# Altium schematic sheet cgra.SchDoc
size D
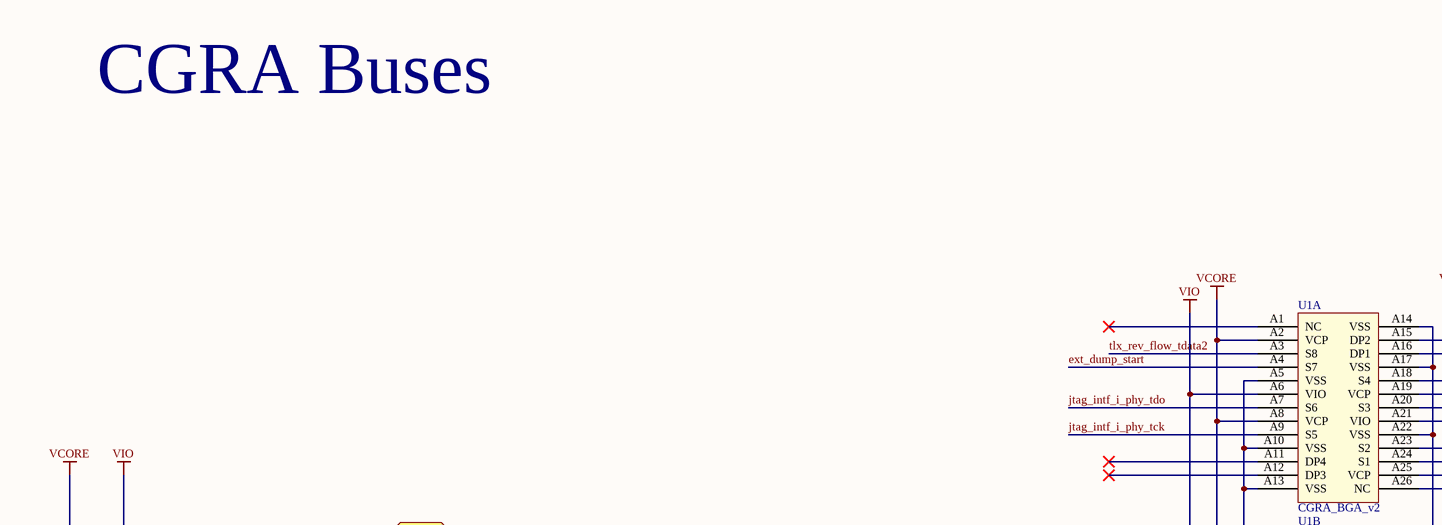
[diagram p0: cgra.SchDoc, top left]
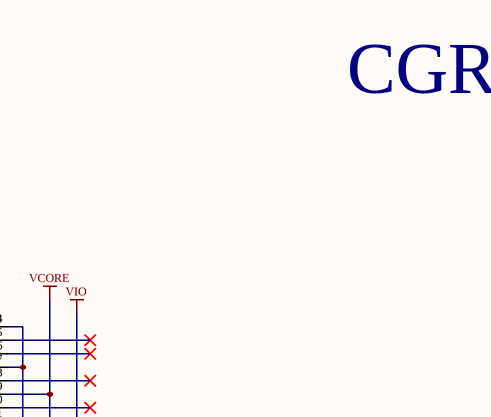
[diagram p1: cgra.SchDoc, top middle]
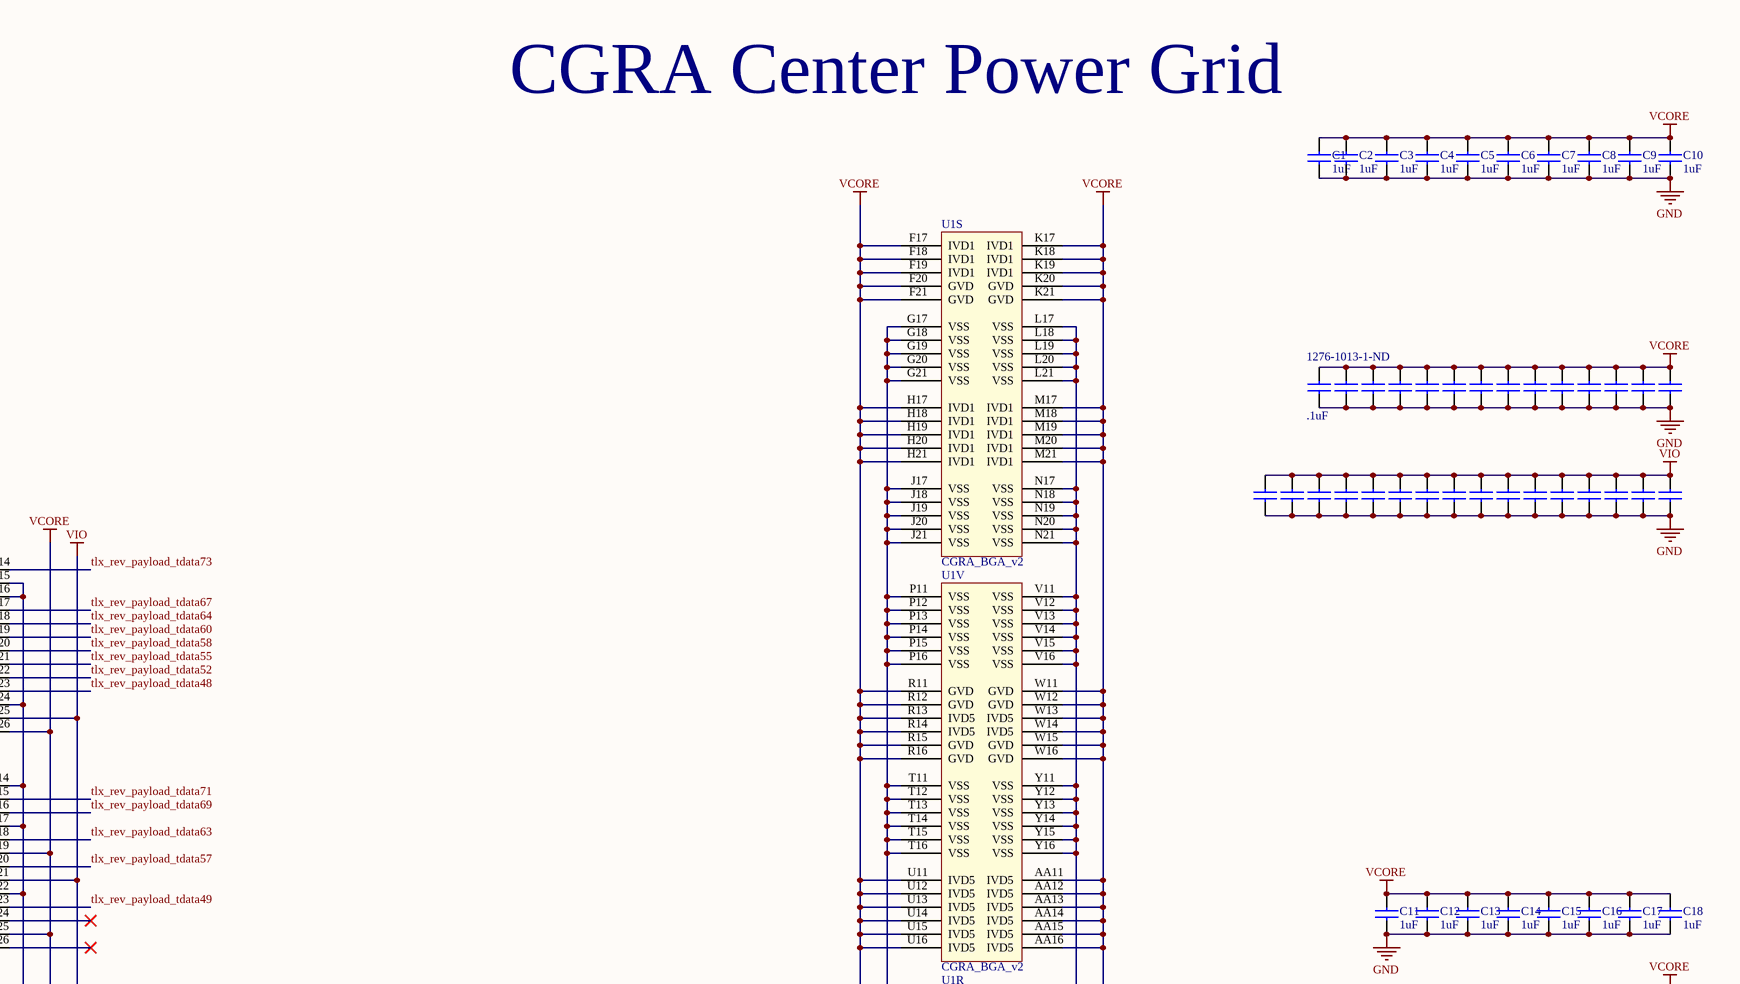
[diagram p2: cgra.SchDoc, top right]
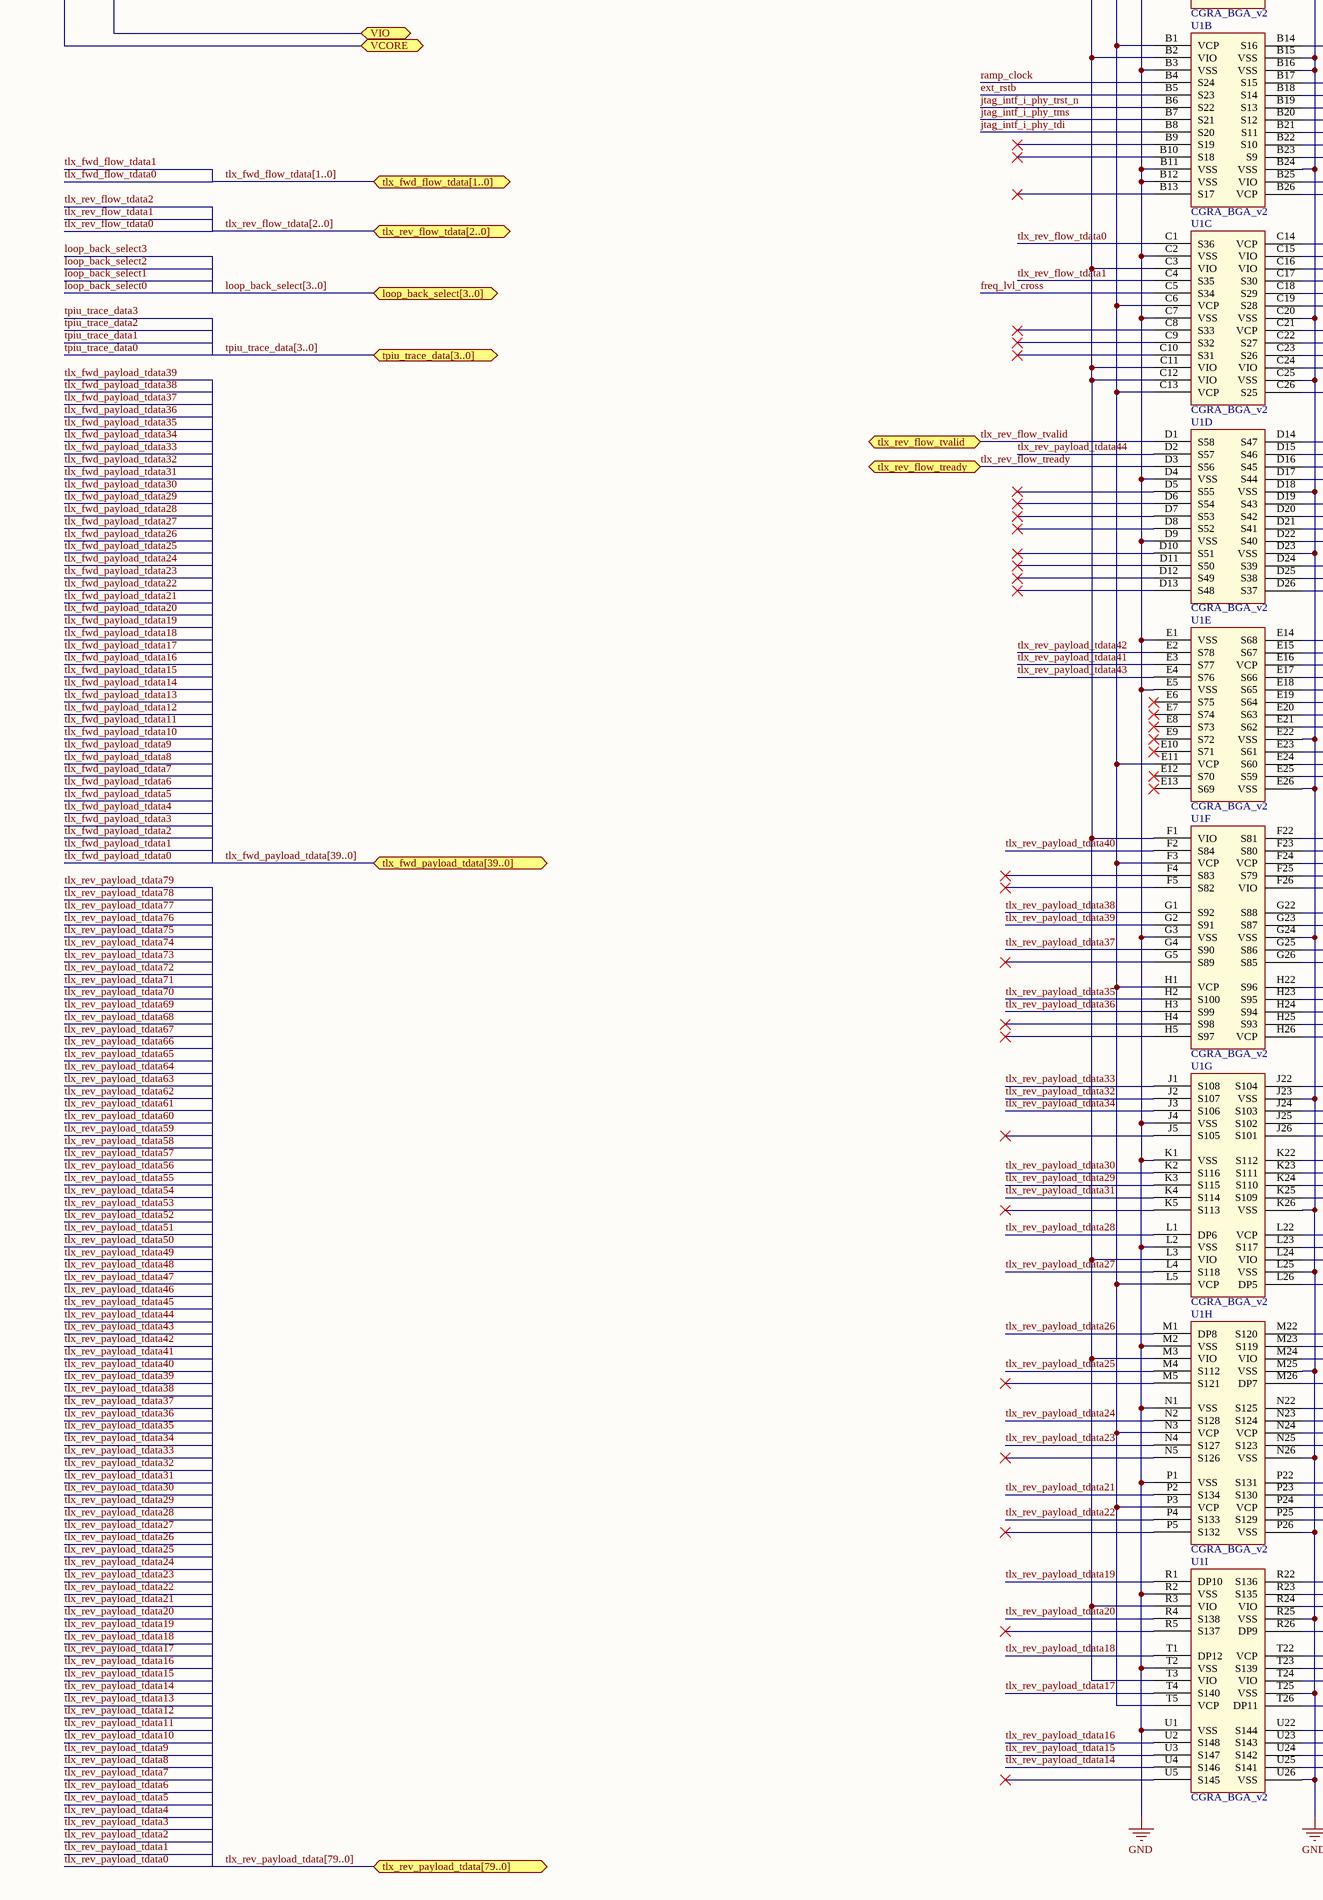
[diagram p3: cgra.SchDoc, bottom left]
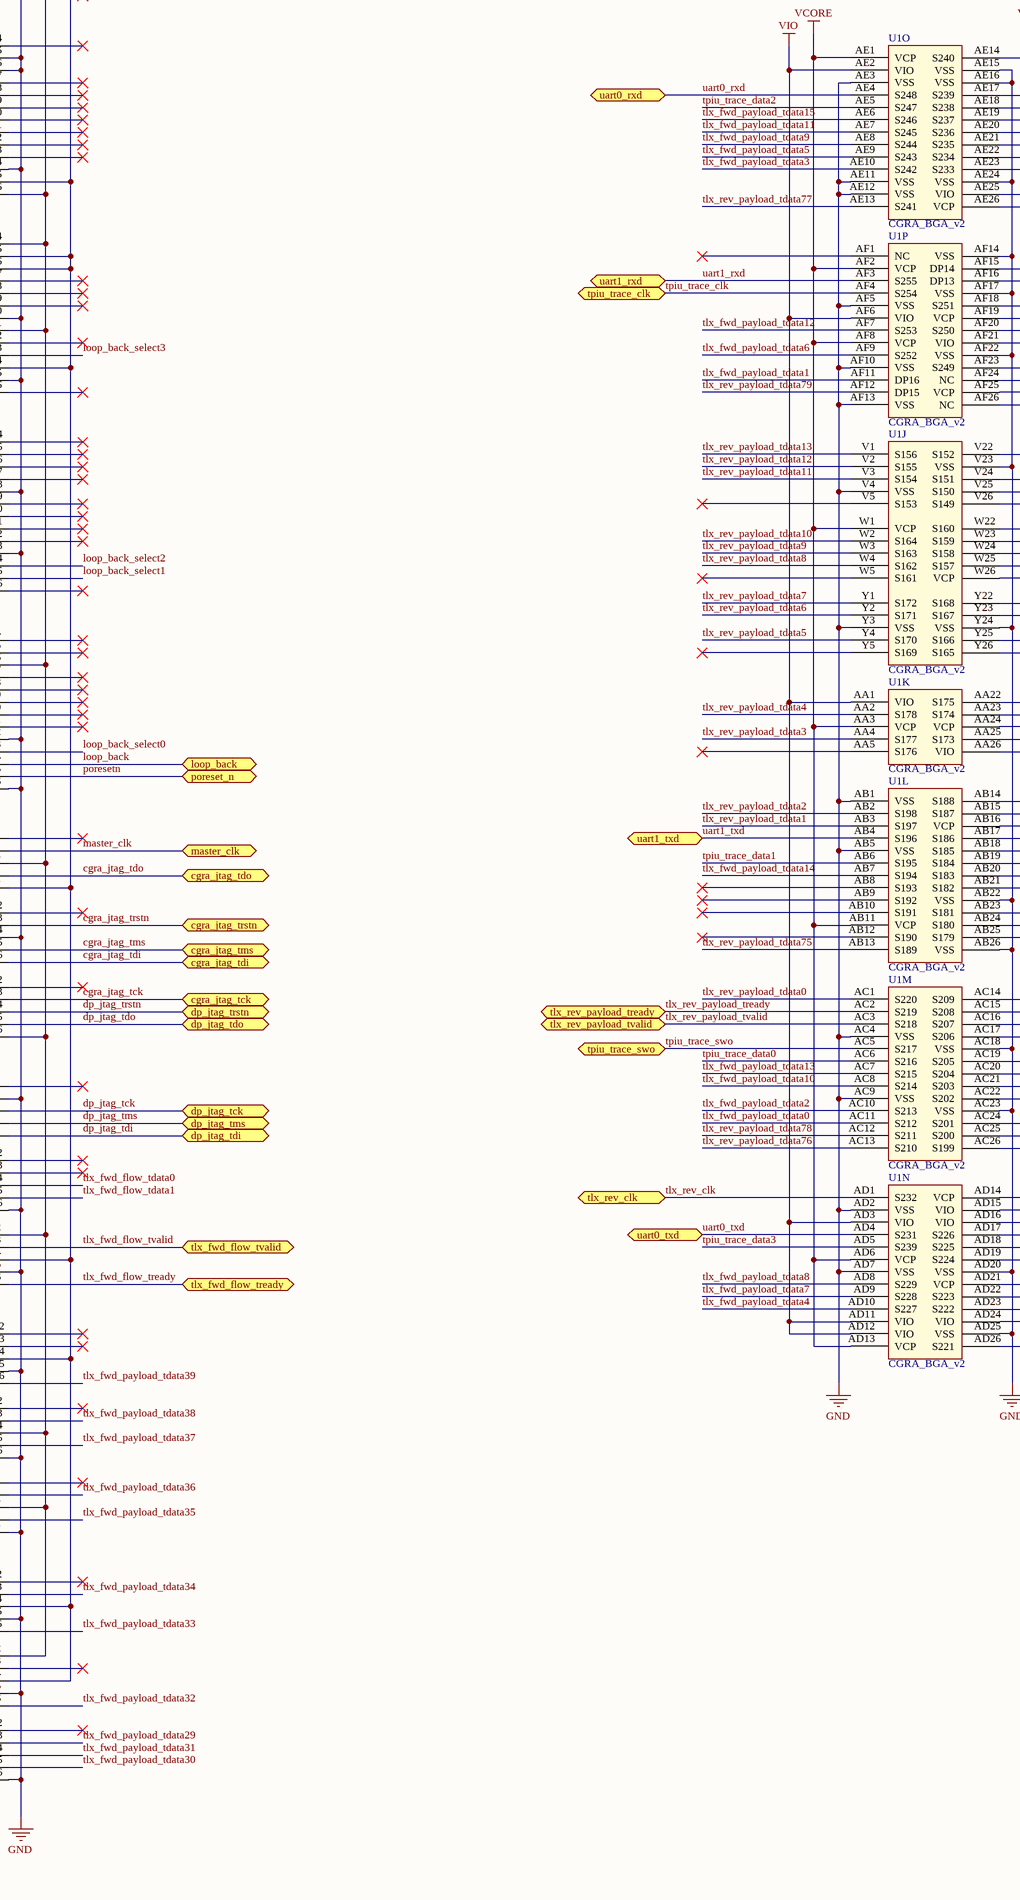
[diagram p4: cgra.SchDoc, bottom middle]
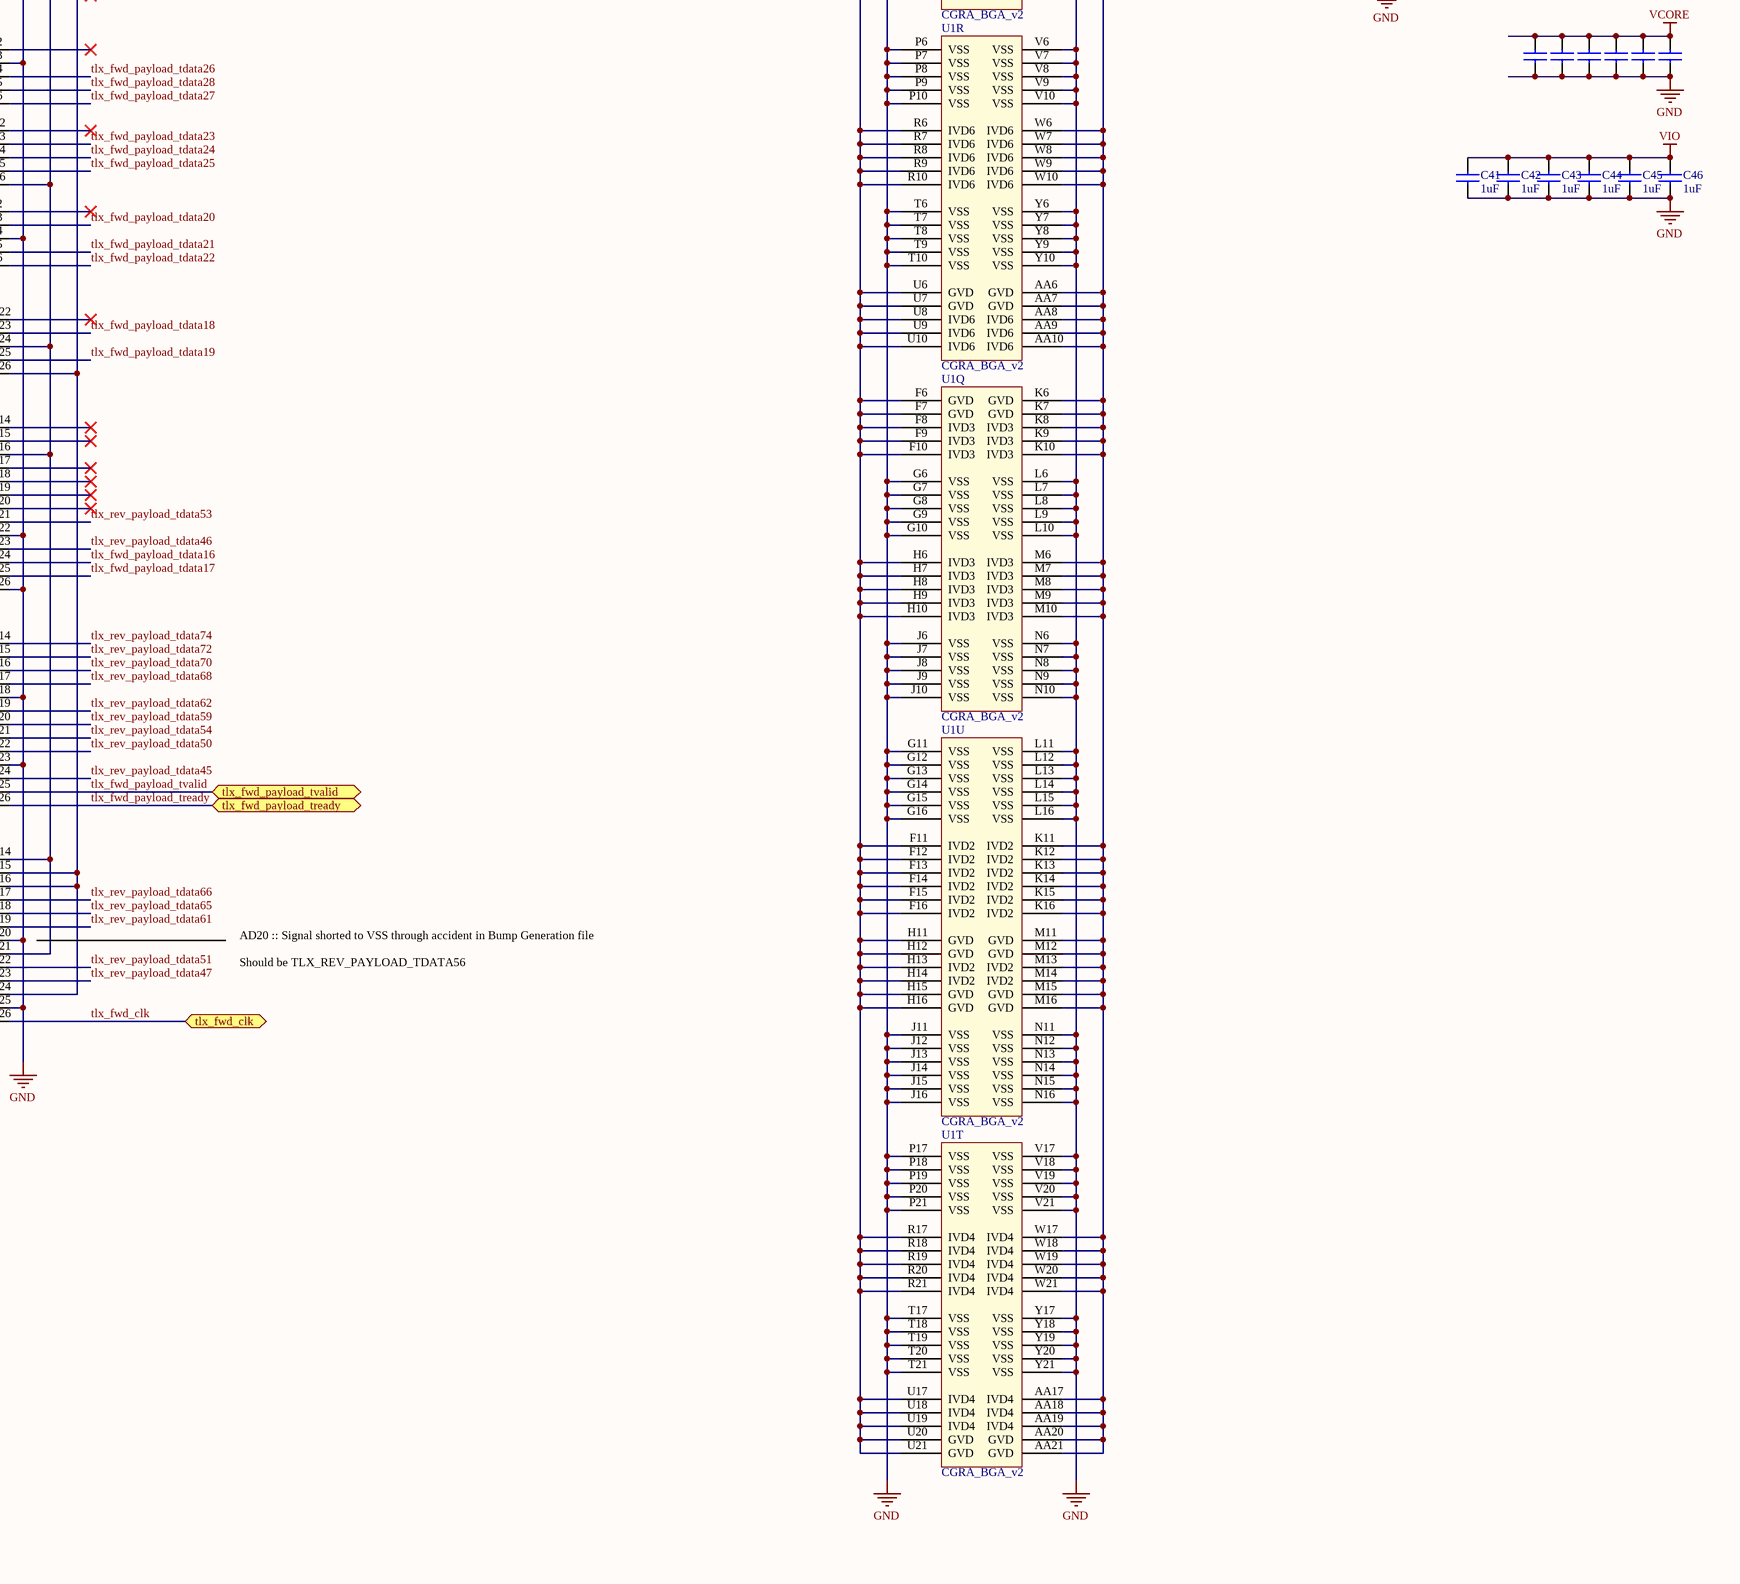
[diagram p5: cgra.SchDoc, bottom right]

## Parts
C1  Capacitance: 1uF  [CAPC2012X14N]  (hidden comment: CAP_1uF_0805_25V)
C2  Capacitance: 1uF  [CAPC2012X14N]  (hidden comment: CAP_1uF_0805_25V)
C3  Capacitance: 1uF  [CAPC2012X14N]  (hidden comment: CAP_1uF_0805_25V)
C4  Capacitance: 1uF  [CAPC2012X14N]  (hidden comment: CAP_1uF_0805_25V)
C5  Capacitance: 1uF  [CAPC2012X14N]  (hidden comment: CAP_1uF_0805_25V)
C6  Capacitance: 1uF  [CAPC2012X14N]  (hidden comment: CAP_1uF_0805_25V)
C7  Capacitance: 1uF  [CAPC2012X14N]  (hidden comment: CAP_1uF_0805_25V)
C8  Capacitance: 1uF  [CAPC2012X14N]  (hidden comment: CAP_1uF_0805_25V)
C9  Capacitance: 1uF  [CAPC2012X14N]  (hidden comment: CAP_1uF_0805_25V)
C10  Capacitance: 1uF  [CAPC2012X14N]  (hidden comment: CAP_1uF_0805_25V)
C11  Capacitance: 1uF  [CAPC2012X14N]  (hidden comment: CAP_1uF_0805_25V)
C12  Capacitance: 1uF  [CAPC2012X14N]  (hidden comment: CAP_1uF_0805_25V)
C13  Capacitance: 1uF  [CAPC2012X14N]  (hidden comment: CAP_1uF_0805_25V)
C14  Capacitance: 1uF  [CAPC2012X14N]  (hidden comment: CAP_1uF_0805_25V)
C15  Capacitance: 1uF  [CAPC2012X14N]  (hidden comment: CAP_1uF_0805_25V)
C16  Capacitance: 1uF  [CAPC2012X14N]  (hidden comment: CAP_1uF_0805_25V)
C17  Capacitance: 1uF  [CAPC2012X14N]  (hidden comment: CAP_1uF_0805_25V)
C18  Capacitance: 1uF  [CAPC2012X14N]  (hidden comment: CAP_1uF_0805_25V)
C19  Capacitance: .1uF  Supplier Part Number 1: 1276-1013-1-ND  [CAPC0603X02N]  (hidden comment: cap)
C20  cap  [CAPC0603X02N]  (value not drawn)
C21  cap  [CAPC0603X02N]  (value not drawn)
C22  cap  [CAPC0603X02N]  (value not drawn)
C23  cap  [CAPC0603X02N]  (value not drawn)
C24  cap  [CAPC0603X02N]  (value not drawn)
C25  cap  [CAPC0603X02N]  (value not drawn)
C26  cap  [CAPC0603X02N]  (value not drawn)
C27  cap  [CAPC0603X02N]  (value not drawn)
C28  cap  [CAPC0603X02N]  (value not drawn)
C29  cap  [CAPC0603X02N]  (value not drawn)
C30  cap  [CAPC0603X02N]  (value not drawn)
C31  cap  [CAPC0603X02N]  (value not drawn)
C32  cap  [CAPC0603X02N]  (value not drawn)
C41  Capacitance: 1uF  [CAPC2012X14N]  (hidden comment: CAP_1uF_0805_25V)
C42  Capacitance: 1uF  [CAPC2012X14N]  (hidden comment: CAP_1uF_0805_25V)
C43  Capacitance: 1uF  [CAPC2012X14N]  (hidden comment: CAP_1uF_0805_25V)
C44  Capacitance: 1uF  [CAPC2012X14N]  (hidden comment: CAP_1uF_0805_25V)
C45  Capacitance: 1uF  [CAPC2012X14N]  (hidden comment: CAP_1uF_0805_25V)
C46  Capacitance: 1uF  [CAPC2012X14N]  (hidden comment: CAP_1uF_0805_25V)
C96  cap  [CAPC0603X02N]  (value not drawn)
C97  cap  [CAPC0603X02N]  (value not drawn)
C98  cap  [CAPC0603X02N]  (value not drawn)
C99  cap  [CAPC0603X02N]  (value not drawn)
C100  cap  [CAPC0603X02N]  (value not drawn)
C101  cap  [CAPC0603X02N]  (value not drawn)
C106  cap  [CAPC0603X02N]  (value not drawn)
C107  cap  [CAPC0603X02N]  (value not drawn)
C108  cap  [CAPC0603X02N]  (value not drawn)
C109  cap  [CAPC0603X02N]  (value not drawn)
C110  cap  [CAPC0603X02N]  (value not drawn)
C111  cap  [CAPC0603X02N]  (value not drawn)
C112  cap  [CAPC0603X02N]  (value not drawn)
C113  cap  [CAPC0603X02N]  (value not drawn)
C114  cap  [CAPC0603X02N]  (value not drawn)
C115  cap  [CAPC0603X02N]  (value not drawn)
C116  cap  [CAPC0603X02N]  (value not drawn)
C117  cap  [CAPC0603X02N]  (value not drawn)
C118  cap  [CAPC0603X02N]  (value not drawn)
C119  cap  [CAPC0603X02N]  (value not drawn)
C120  cap  [CAPC0603X02N]  (value not drawn)
C121  cap  [CAPC0603X02N]  (value not drawn)
U1  CGRA_BGA_v2  [BGA676x26]  (parts A,B,C,D,E,F,G,H,I,J,K,L,M,N,O,P,Q,R,S,T,U,V of 22)

## Ports
cgra_jtag_tck (bidir), cgra_jtag_tdi (bidir), cgra_jtag_tdo (bidir), cgra_jtag_tms (bidir), cgra_jtag_trstn (bidir), dp_jtag_tck (bidir), dp_jtag_tdi (bidir), dp_jtag_tdo (bidir), dp_jtag_tms (bidir), dp_jtag_trstn (bidir), loop_back (bidir), loop_back_select[3..0] (bidir), master_clk (bidir), poreset_n (bidir), tlx_fwd_clk (bidir), tlx_fwd_flow_tdata[1..0] (bidir), tlx_fwd_flow_tready (bidir), tlx_fwd_flow_tvalid (bidir), tlx_fwd_payload_tdata[39..0] (bidir), tlx_fwd_payload_tready (bidir), tlx_fwd_payload_tvalid (bidir), tlx_rev_clk (bidir), tlx_rev_flow_tdata[2..0] (bidir), tlx_rev_flow_tready (bidir), tlx_rev_flow_tvalid (bidir), tlx_rev_payload_tdata[79..0] (bidir), tlx_rev_payload_tready (bidir), tlx_rev_payload_tvalid (bidir), tpiu_trace_clk (bidir), tpiu_trace_data[3..0] (bidir), tpiu_trace_swo (bidir), uart0_rxd (bidir), uart0_txd (bidir), uart1_rxd (bidir), uart1_txd (bidir), VCORE (bidir), VIO (bidir)

## Nets
GND: C1.2 C2.2 C3.2 C4.2 C5.2 C6.2 C7.2 C8.2 C9.2 C10.2 C11.2 C12.2 C13.2 C14.2 C15.2 C16.2 C17.2 C18.2 C19.2 C20.2 C21.2 C22.2 C23.2 C24.2 C25.2 C26.2 C27.2 C28.2 C29.2 C30.2 C31.2 C32.2 C41.2 C42.2 C43.2 C44.2 C45.2 C46.2 C96.2 C97.2 C98.2 C99.2 C100.2 C101.2 C106.2 C107.2 C108.2 C109.2 C110.2 C111.2 C112.2 C113.2 C114.2 C115.2 C116.2 C117.2 C118.2 C119.2 C120.2 C121.2 U1.A5(VSS) U1.A10(VSS) U1.A13(VSS) U1.A14(VSS) U1.A17(VSS) U1.A22(VSS) U1.AB1(VSS) U1.AB5(VSS) U1.AB22(VSS) U1.AB26(VSS) U1.AC4(VSS) U1.AC9(VSS) U1.AC18(VSS) U1.AC23(VSS) U1.AD2(VSS) U1.AD7(VSS) U1.AD20(VSS) U1.AD25(VSS) U1.AE3(VSS) U1.AE11(VSS) U1.AE12(VSS) U1.AE15(VSS) U1.AE16(VSS) U1.AE24(VSS) U1.AF5(VSS) U1.AF10(VSS) U1.AF13(VSS) U1.AF14(VSS) U1.AF17(VSS) U1.AF22(VSS) U1.B3(VSS) U1.B11(VSS) U1.B12(VSS) U1.B15(VSS) U1.B16(VSS) U1.B24(VSS) U1.C2(VSS) U1.C7(VSS) U1.C20(VSS) U1.C25(VSS) U1.D4(VSS) U1.D9(VSS) U1.D18(VSS) U1.D23(VSS) U1.E1(VSS) U1.E5(VSS) U1.E22(VSS) U1.E26(VSS) U1.G3(VSS) U1.G6(VSS) U1.G7(VSS) U1.G8(VSS) U1.G9(VSS) U1.G10(VSS) U1.G11(VSS) U1.G12(VSS) U1.G13(VSS) U1.G14(VSS) U1.G15(VSS) U1.G16(VSS) U1.G17(VSS) U1.G18(VSS) U1.G19(VSS) U1.G20(VSS) U1.G21(VSS) U1.G24(VSS) U1.J4(VSS) U1.J6(VSS) U1.J7(VSS) U1.J8(VSS) U1.J9(VSS) U1.J10(VSS) U1.J11(VSS) U1.J12(VSS) U1.J13(VSS) U1.J14(VSS) U1.J15(VSS) U1.J16(VSS) U1.J17(VSS) U1.J18(VSS) U1.J19(VSS) U1.J20(VSS) U1.J21(VSS) U1.J23(VSS) U1.K1(VSS) U1.K26(VSS) U1.L2(VSS) U1.L6(VSS) U1.L7(VSS) U1.L8(VSS) U1.L9(VSS) U1.L10(VSS) U1.L11(VSS) U1.L12(VSS) U1.L13(VSS) U1.L14(VSS) U1.L15(VSS) U1.L16(VSS) U1.L17(VSS) U1.L18(VSS) U1.L19(VSS) U1.L20(VSS) U1.L21(VSS) U1.L25(VSS) U1.M2(VSS) U1.M25(VSS) U1.N1(VSS) U1.N6(VSS) U1.N7(VSS) U1.N8(VSS) U1.N9(VSS) U1.N10(VSS) U1.N11(VSS) U1.N12(VSS) U1.N13(VSS) U1.N14(VSS) U1.N15(VSS) U1.N16(VSS) U1.N17(VSS) U1.N18(VSS) U1.N19(VSS) U1.N20(VSS) U1.N21(VSS) U1.N26(VSS) U1.P1(VSS) U1.P6(VSS) U1.P7(VSS) U1.P8(VSS) U1.P9(VSS) U1.P10(VSS) U1.P11(VSS) U1.P12(VSS) U1.P13(VSS) U1.P14(VSS) U1.P15(VSS) U1.P16(VSS) U1.P17(VSS) U1.P18(VSS) U1.P19(VSS) U1.P20(VSS) U1.P21(VSS) U1.P26(VSS) U1.R2(VSS) U1.R25(VSS) U1.T2(VSS) U1.T6(VSS) U1.T7(VSS) U1.T8(VSS) U1.T9(VSS) U1.T10(VSS) U1.T11(VSS) U1.T12(VSS) U1.T13(VSS) U1.T14(VSS) U1.T15(VSS) U1.T16(VSS) U1.T17(VSS) U1.T18(VSS) U1.T19(VSS) U1.T20(VSS) U1.T21(VSS) U1.T25(VSS) U1.U1(VSS) U1.U26(VSS) U1.V4(VSS) U1.V6(VSS) U1.V7(VSS) U1.V8(VSS) U1.V9(VSS) U1.V10(VSS) U1.V11(VSS) U1.V12(VSS) U1.V13(VSS) U1.V14(VSS) U1.V15(VSS) U1.V16(VSS) U1.V17(VSS) U1.V18(VSS) U1.V19(VSS) U1.V20(VSS) U1.V21(VSS) U1.V23(VSS) U1.Y3(VSS) U1.Y6(VSS) U1.Y7(VSS) U1.Y8(VSS) U1.Y9(VSS) U1.Y10(VSS) U1.Y11(VSS) U1.Y12(VSS) U1.Y13(VSS) U1.Y14(VSS) U1.Y15(VSS) U1.Y16(VSS) U1.Y17(VSS) U1.Y18(VSS) U1.Y19(VSS) U1.Y20(VSS) U1.Y21(VSS) U1.Y24(VSS)
VCORE: C1.1 C2.1 C3.1 C4.1 C5.1 C6.1 C7.1 C8.1 C9.1 C10.1 C11.1 C12.1 C13.1 C14.1 C15.1 C16.1 C17.1 C18.1 C19.1 C20.1 C21.1 C22.1 C23.1 C24.1 C25.1 C26.1 C27.1 C28.1 C29.1 C30.1 C31.1 C32.1 C96.1 C97.1 C98.1 C99.1 C100.1 C101.1 U1.A2(VCP) U1.A8(VCP) U1.A19(VCP) U1.A25(VCP) U1.AA3(VCP) U1.AA6(GVD) U1.AA7(GVD) U1.AA8(IVD6) U1.AA9(IVD6) U1.AA10(IVD6) U1.AA11(IVD5) U1.AA12(IVD5) U1.AA13(IVD5) U1.AA14(IVD5) U1.AA15(IVD5) U1.AA16(IVD5) U1.AA17(IVD4) U1.AA18(IVD4) U1.AA19(IVD4) U1.AA20(GVD) U1.AA21(GVD) U1.AA24(VCP) U1.AB11(VCP) U1.AB16(VCP) U1.AD6(VCP) U1.AD13(VCP) U1.AD14(VCP) U1.AD21(VCP) U1.AE1(VCP) U1.AE26(VCP) U1.AF2(VCP) U1.AF8(VCP) U1.AF19(VCP) U1.AF25(VCP) U1.B1(VCP) U1.B26(VCP) U1.C6(VCP) U1.C13(VCP) U1.C14(VCP) U1.C21(VCP) U1.E11(VCP) U1.E16(VCP) U1.F3(VCP) U1.F6(GVD) U1.F7(GVD) U1.F8(IVD3) U1.F9(IVD3) U1.F10(IVD3) U1.F11(IVD2) U1.F12(IVD2) U1.F13(IVD2) U1.F14(IVD2) U1.F15(IVD2) U1.F16(IVD2) U1.F17(IVD1) U1.F18(IVD1) U1.F19(IVD1) U1.F20(GVD) U1.F21(GVD) U1.F24(VCP) U1.H1(VCP) U1.H6(IVD3) U1.H7(IVD3) U1.H8(IVD3) U1.H9(IVD3) U1.H10(IVD3) U1.H11(GVD) U1.H12(GVD) U1.H13(IVD2) U1.H14(IVD2) U1.H15(GVD) U1.H16(GVD) U1.H17(IVD1) U1.H18(IVD1) U1.H19(IVD1) U1.H20(IVD1) U1.H21(IVD1) U1.H26(VCP) U1.K6(GVD) U1.K7(GVD) U1.K8(IVD3) U1.K9(IVD3) U1.K10(IVD3) U1.K11(IVD2) U1.K12(IVD2) U1.K13(IVD2) U1.K14(IVD2) U1.K15(IVD2) U1.K16(IVD2) U1.K17(IVD1) U1.K18(IVD1) U1.K19(IVD1) U1.K20(GVD) U1.K21(GVD) U1.L5(VCP) U1.L22(VCP) U1.M6(IVD3) U1.M7(IVD3) U1.M8(IVD3) U1.M9(IVD3) U1.M10(IVD3) U1.M11(GVD) U1.M12(GVD) U1.M13(IVD2) U1.M14(IVD2) U1.M15(GVD) U1.M16(GVD) U1.M17(IVD1) U1.M18(IVD1) U1.M19(IVD1) U1.M20(IVD1) U1.M21(IVD1) U1.N3(VCP) U1.N24(VCP) U1.P3(VCP) U1.P24(VCP) U1.R6(IVD6) U1.R7(IVD6) U1.R8(IVD6) U1.R9(IVD6) U1.R10(IVD6) U1.R11(GVD) U1.R12(GVD) U1.R13(IVD5) U1.R14(IVD5) U1.R15(GVD) U1.R16(GVD) U1.R17(IVD4) U1.R18(IVD4) U1.R19(IVD4) U1.R20(IVD4) U1.R21(IVD4) U1.T5(VCP) U1.T22(VCP) U1.U6(GVD) U1.U7(GVD) U1.U8(IVD6) U1.U9(IVD6) U1.U10(IVD6) U1.U11(IVD5) U1.U12(IVD5) U1.U13(IVD5) U1.U14(IVD5) U1.U15(IVD5) U1.U16(IVD5) U1.U17(IVD4) U1.U18(IVD4) U1.U19(IVD4) U1.U20(GVD) U1.U21(GVD) U1.W1(VCP) U1.W6(IVD6) U1.W7(IVD6) U1.W8(IVD6) U1.W9(IVD6) U1.W10(IVD6) U1.W11(GVD) U1.W12(GVD) U1.W13(IVD5) U1.W14(IVD5) U1.W15(GVD) U1.W16(GVD) U1.W17(IVD4) U1.W18(IVD4) U1.W19(IVD4) U1.W20(IVD4) U1.W21(IVD4) U1.W26(VCP) ; port VCORE
VIO: C41.1 C42.1 C43.1 C44.1 C45.1 C46.1 C106.1 C107.1 C108.1 C109.1 C110.1 C111.1 C112.1 C113.1 C114.1 C115.1 C116.1 C117.1 C118.1 C119.1 C120.1 C121.1 U1.A6(VIO) U1.A21(VIO) U1.AA1(VIO) U1.AA26(VIO) U1.AD3(VIO) U1.AD11(VIO) U1.AD12(VIO) U1.AD15(VIO) U1.AD16(VIO) U1.AD24(VIO) U1.AE2(VIO) U1.AE25(VIO) U1.AF6(VIO) U1.AF21(VIO) U1.B2(VIO) U1.B25(VIO) U1.C3(VIO) U1.C11(VIO) U1.C12(VIO) U1.C15(VIO) U1.C16(VIO) U1.C24(VIO) U1.F1(VIO) U1.F26(VIO) U1.L3(VIO) U1.L24(VIO) U1.M3(VIO) U1.M24(VIO) U1.R3(VIO) U1.R24(VIO) U1.T3(VIO) U1.T24(VIO) ; port VIO
cgra_jtag_tck: U1.H23(S95) ; port cgra_jtag_tck
cgra_jtag_tdi: U1.G26(S85) ; port cgra_jtag_tdi
cgra_jtag_tdo: U1.F25(S79) ; port cgra_jtag_tdo
cgra_jtag_tms: U1.G25(S86) ; port cgra_jtag_tms
cgra_jtag_trstn: U1.G23(S87) ; port cgra_jtag_trstn
dp_jtag_tck: U1.J24(S103) ; port dp_jtag_tck
dp_jtag_tdi: U1.J26(S101) ; port dp_jtag_tdi
dp_jtag_tdo: U1.H25(S93) ; port dp_jtag_tdo
dp_jtag_tms: U1.J25(S102) ; port dp_jtag_tms
dp_jtag_trstn: U1.H24(S94) ; port dp_jtag_trstn
ext_dump_start: U1.A4(S7)
ext_rstb: U1.B5(S23)
freq_lvl_cross: U1.C5(S34)
jtag_intf_i_phy_tck: U1.A9(S5)
jtag_intf_i_phy_tdi: U1.B8(S20)
jtag_intf_i_phy_tdo: U1.A7(S6)
jtag_intf_i_phy_tms: U1.B7(S21)
jtag_intf_i_phy_trst_n: U1.B6(S22)
loop_back: U1.E24(S60) ; port loop_back
loop_back_select0: U1.E23(S61)
loop_back_select1: U1.D25(S38)
loop_back_select2: U1.D24(S39)
loop_back_select3: U1.C23(S26)
master_clk: U1.F23(S80) ; port master_clk
poresetn: U1.E25(S59) ; port poreset_n
ramp_clock: U1.B4(S24)
tlx_fwd_clk: U1.AD26(S221) ; port tlx_fwd_clk
tlx_fwd_flow_tdata0: U1.K24(S110)
tlx_fwd_flow_tdata1: U1.K25(S109)
tlx_fwd_flow_tready: U1.L26(DP5) ; port tlx_fwd_flow_tready
tlx_fwd_flow_tvalid: U1.L23(S117) ; port tlx_fwd_flow_tvalid
tlx_fwd_payload_tdata0: U1.AC11(S212)
tlx_fwd_payload_tdata1: U1.AF11(DP16)
tlx_fwd_payload_tdata2: U1.AC10(S213)
tlx_fwd_payload_tdata3: U1.AE10(S242)
tlx_fwd_payload_tdata4: U1.AD10(S227)
tlx_fwd_payload_tdata5: U1.AE9(S243)
tlx_fwd_payload_tdata6: U1.AF9(S252)
tlx_fwd_payload_tdata7: U1.AD9(S228)
tlx_fwd_payload_tdata8: U1.AD8(S229)
tlx_fwd_payload_tdata9: U1.AE8(S244)
tlx_fwd_payload_tdata10: U1.AC8(S214)
tlx_fwd_payload_tdata11: U1.AE7(S245)
tlx_fwd_payload_tdata12: U1.AF7(S253)
tlx_fwd_payload_tdata13: U1.AC7(S215)
tlx_fwd_payload_tdata14: U1.AB7(S194)
tlx_fwd_payload_tdata15: U1.AE6(S246)
tlx_fwd_payload_tdata16: U1.AB24(S180)
tlx_fwd_payload_tdata17: U1.AB25(S179)
tlx_fwd_payload_tdata18: U1.AA23(S174)
tlx_fwd_payload_tdata19: U1.AA25(S173)
tlx_fwd_payload_tdata20: U1.Y23(S167)
tlx_fwd_payload_tdata21: U1.Y25(S166)
tlx_fwd_payload_tdata22: U1.Y26(S165)
tlx_fwd_payload_tdata23: U1.W23(S159)
tlx_fwd_payload_tdata24: U1.W24(S158)
tlx_fwd_payload_tdata25: U1.W25(S157)
tlx_fwd_payload_tdata26: U1.V24(S151)
tlx_fwd_payload_tdata27: U1.V26(S149)
tlx_fwd_payload_tdata28: U1.V25(S150)
tlx_fwd_payload_tdata29: U1.U23(S143)
tlx_fwd_payload_tdata30: U1.U25(S141)
tlx_fwd_payload_tdata31: U1.U24(S142)
tlx_fwd_payload_tdata32: U1.T26(DP11)
tlx_fwd_payload_tdata33: U1.R26(DP9)
tlx_fwd_payload_tdata34: U1.R23(S135)
tlx_fwd_payload_tdata35: U1.P25(S129)
tlx_fwd_payload_tdata36: U1.P23(S130)
tlx_fwd_payload_tdata37: U1.N25(S123)
tlx_fwd_payload_tdata38: U1.N23(S124)
tlx_fwd_payload_tdata39: U1.M26(DP7)
tlx_fwd_payload_tready: U1.AC26(S199) ; port tlx_fwd_payload_tready
tlx_fwd_payload_tvalid: U1.AC25(S200) ; port tlx_fwd_payload_tvalid
tlx_rev_clk: U1.AD1(S232) ; port tlx_rev_clk
tlx_rev_flow_tdata0: U1.C1(S36)
tlx_rev_flow_tdata1: U1.C4(S35)
tlx_rev_flow_tdata2: U1.A3(S8)
tlx_rev_flow_tready: U1.D3(S56) ; port tlx_rev_flow_tready
tlx_rev_flow_tvalid: U1.D1(S58) ; port tlx_rev_flow_tvalid
tlx_rev_payload_tdata0: U1.AC1(S220)
tlx_rev_payload_tdata1: U1.AB3(S197)
tlx_rev_payload_tdata2: U1.AB2(S198)
tlx_rev_payload_tdata3: U1.AA4(S177)
tlx_rev_payload_tdata4: U1.AA2(S178)
tlx_rev_payload_tdata5: U1.Y4(S170)
tlx_rev_payload_tdata6: U1.Y2(S171)
tlx_rev_payload_tdata7: U1.Y1(S172)
tlx_rev_payload_tdata8: U1.W4(S162)
tlx_rev_payload_tdata9: U1.W3(S163)
tlx_rev_payload_tdata10: U1.W2(S164)
tlx_rev_payload_tdata11: U1.V3(S154)
tlx_rev_payload_tdata12: U1.V2(S155)
tlx_rev_payload_tdata13: U1.V1(S156)
tlx_rev_payload_tdata14: U1.U4(S146)
tlx_rev_payload_tdata15: U1.U3(S147)
tlx_rev_payload_tdata16: U1.U2(S148)
tlx_rev_payload_tdata17: U1.T4(S140)
tlx_rev_payload_tdata18: U1.T1(DP12)
tlx_rev_payload_tdata19: U1.R1(DP10)
tlx_rev_payload_tdata20: U1.R4(S138)
tlx_rev_payload_tdata21: U1.P2(S134)
tlx_rev_payload_tdata22: U1.P4(S133)
tlx_rev_payload_tdata23: U1.N4(S127)
tlx_rev_payload_tdata24: U1.N2(S128)
tlx_rev_payload_tdata25: U1.M4(S112)
tlx_rev_payload_tdata26: U1.M1(DP8)
tlx_rev_payload_tdata27: U1.L4(S118)
tlx_rev_payload_tdata28: U1.L1(DP6)
tlx_rev_payload_tdata29: U1.K3(S115)
tlx_rev_payload_tdata30: U1.K2(S116)
tlx_rev_payload_tdata31: U1.K4(S114)
tlx_rev_payload_tdata32: U1.J2(S107)
tlx_rev_payload_tdata33: U1.J1(S108)
tlx_rev_payload_tdata34: U1.J3(S106)
tlx_rev_payload_tdata35: U1.H2(S100)
tlx_rev_payload_tdata36: U1.H3(S99)
tlx_rev_payload_tdata37: U1.G4(S90)
tlx_rev_payload_tdata38: U1.G1(S92)
tlx_rev_payload_tdata39: U1.G2(S91)
tlx_rev_payload_tdata40: U1.F2(S84)
tlx_rev_payload_tdata41: U1.E3(S77)
tlx_rev_payload_tdata42: U1.E2(S78)
tlx_rev_payload_tdata43: U1.E4(S76)
tlx_rev_payload_tdata44: U1.D2(S57)
tlx_rev_payload_tdata45: U1.AC24(S201)
tlx_rev_payload_tdata46: U1.AB23(S181)
tlx_rev_payload_tdata47: U1.AD23(S222)
tlx_rev_payload_tdata48: U1.AE23(S233)
tlx_rev_payload_tdata49: U1.AF23(S249)
tlx_rev_payload_tdata50: U1.AC22(S202)
tlx_rev_payload_tdata51: U1.AD22(S223)
tlx_rev_payload_tdata52: U1.AE22(S234)
tlx_rev_payload_tdata53: U1.AB21(S182)
tlx_rev_payload_tdata54: U1.AC21(S203)
tlx_rev_payload_tdata55: U1.AE21(S235)
tlx_rev_payload_tdata57: U1.AF20(S250)
tlx_rev_payload_tdata58: U1.AE20(S236)
tlx_rev_payload_tdata59: U1.AC20(S204)
tlx_rev_payload_tdata60: U1.AE19(S237)
tlx_rev_payload_tdata61: U1.AD19(S224)
tlx_rev_payload_tdata62: U1.AC19(S205)
tlx_rev_payload_tdata63: U1.AF18(S251)
tlx_rev_payload_tdata64: U1.AE18(S238)
tlx_rev_payload_tdata65: U1.AD18(S225)
tlx_rev_payload_tdata66: U1.AD17(S226)
tlx_rev_payload_tdata67: U1.AE17(S239)
tlx_rev_payload_tdata68: U1.AC17(S206)
tlx_rev_payload_tdata69: U1.AF16(DP13)
tlx_rev_payload_tdata70: U1.AC16(S207)
tlx_rev_payload_tdata71: U1.AF15(DP14)
tlx_rev_payload_tdata72: U1.AC15(S208)
tlx_rev_payload_tdata73: U1.AE14(S240)
tlx_rev_payload_tdata74: U1.AC14(S209)
tlx_rev_payload_tdata75: U1.AB13(S189)
tlx_rev_payload_tdata76: U1.AC13(S210)
tlx_rev_payload_tdata77: U1.AE13(S241)
tlx_rev_payload_tdata78: U1.AC12(S211)
tlx_rev_payload_tdata79: U1.AF12(DP15)
tlx_rev_payload_tready: U1.AC2(S219) ; port tlx_rev_payload_tready
tlx_rev_payload_tvalid: U1.AC3(S218) ; port tlx_rev_payload_tvalid
tpiu_trace_clk: U1.AF4(S254) ; port tpiu_trace_clk
tpiu_trace_data0: U1.AC6(S216)
tpiu_trace_data1: U1.AB6(S195)
tpiu_trace_data2: U1.AE5(S247)
tpiu_trace_data3: U1.AD5(S239)
tpiu_trace_swo: U1.AC5(S217) ; port tpiu_trace_swo
uart0_rxd: U1.AE4(S248) ; port uart0_rxd
uart0_txd: U1.AD4(S231) ; port uart0_txd
uart1_rxd: U1.AF3(S255) ; port uart1_rxd
uart1_txd: U1.AB4(S196) ; port uart1_txd

Not connected (* = marked no-connect by the designer): U1 A1(NC)* A11(DP4)* A12(DP3)* A15(DP2)* A16(DP1)* A18(S4)* A20(S3)* A23(S2)* A24(S1)* A26(NC)* AA5(S176)* AA22(S175)* AB8(S193)* AB9(S192)* AB10(S191)* AB12(S190)* AB14(S188)* AB15(S187)* AB17(S186)* AB18(S185)* AB19(S184)* AB20(S183)* AF1(NC)* AF24(NC)* AF26(NC)* B9(S19)* B10(S18)* B13(S17)* B14(S16)* B17(S15)* B18(S14)* B19(S13)* B20(S12)* B21(S11)* B22(S10)* B23(S9)* C8(S33)* C9(S32)* C10(S31)* C17(S30)* C18(S29)* C19(S28)* C22(S27)* C26(S25)* D5(S55)* D6(S54)* D7(S53)* D8(S52)* D10(S51)* D11(S50)* D12(S49)* D13(S48)* D14(S47)* D15(S46)* D16(S45)* D17(S44)* D19(S43)* D20(S42)* D21(S41)* D22(S40)* D26(S37)* E6(S75)* E7(S74)* E8(S73)* E9(S72)* E10(S71)* E12(S70)* E13(S69)* E14(S68)* E15(S67)* E17(S66)* E18(S65)* E19(S64)* E20(S63)* E21(S62)* F4(S83)* F5(S82)* F22(S81)* G5(S89)* G22(S88)* H4(S98)* H5(S97)* H22(S96)* J5(S105)* J22(S104)* K5(S113)* K22(S112)* K23(S111)* M5(S121)* M22(S120)* M23(S119)* N5(S126)* N22(S125)* P5(S132)* P22(S131)* R5(S137)* R22(S136)* T23(S139)* U5(S145)* U22(S144)* V5(S153)* V22(S152)* W5(S161)* W22(S160)* Y5(S169)* Y22(S168)*

## Buses and harness runs
bus loop_back_select[3..0] = port loop_back_select[3..0]
bus tlx_fwd_flow_tdata[1..0] = port tlx_fwd_flow_tdata[1..0]
bus tlx_fwd_payload_tdata[39..0] = port tlx_fwd_payload_tdata[39..0]
bus tlx_rev_flow_tdata[2..0] = port tlx_rev_flow_tdata[2..0]
bus tlx_rev_payload_tdata[79..0] = port tlx_rev_payload_tdata[79..0]
bus tpiu_trace_data[3..0] = port tpiu_trace_data[3..0]

## Notes on the sheet
- CGRA Buses
- CGRA IO
- CGRA Center Power Grid
- AD20 :: Signal shorted to VSS through accident in Bump Generation file
  Should be TLX_REV_PAYLOAD_TDATA56

## Library data of the parts
C1-C18 C41-C46 = CAP_1uF_0805_25V: CAP CER 1UF 25V X7R 0805; Manufacturer: Yageo; Manufacturer Part Number: CC0805KKX7R8BB105; Tolerance: 10%; Dissipation Factor: 5%; ComponentLink1URL: http://www.samsungsem.com/kr/support/product-search/mlcc/CL21A475KACLRNC.jsp; ComponentLink1Description: http://www.samsungsem.com/kr/support/product-search/mlcc/CL21A475KACLRNC.jsp; Supplier 1: Digi-Key; Stock 1: 30000; Pricing 1: 1=0.33, 10=0.226, 100=0.1145, 500=0.07832, 1000=0.06928 (USD); Mount: Surface Mount; Case/Package: 0805; Min Operating Temperature: -55°C; Max Operating Temperature: 125°C; Packaging: Tape and Reel; Dielectric: X7R; Termination: SMD/SMT; Length: 2mm; Radiation Hardening: No; ComponentLink2URL: http://capacitoredge.kemet.com/capedge2/DataSheet?pn=C0805C105K3RAC7800; ComponentLink2Description: http://capacitoredge.kemet.com/capedge2/DataSheet?pn=C0805C105K3RAC7800; Supplier Part Number 1: 311-1456-1-ND; Case Code (Metric): 2012; Case Code (Imperial): 0805; Package Quantity: 3000; Voltage Rating: 25V; Voltage Rating (DC): 25V; Width: 0.049inch; Thickness: 0.057inch; REACH SVHC: No SVHC; Number of Pins: 2; Composition: Ceramic; Height: 1.25mm; Depth: 1.25mm; Lead Free: Lead Free; Halogen Free: Halogen Free; ComponentLink3URL: http://www.yageo.com/documents/recent/UPY-GPHC_X7R_6.3V-to-50V_18.pdf; ComponentLink3Description: http://www.yageo.com/documents/recent/UPY-GPHC_X7R_6.3V-to-50V_18.pdf; ComponentLink4URL: http://www.mouser.com/ds/2/447/Yageo_UPY-GP_NP0_16V-to-50V_9-358835.pdf; ComponentLink4Description: http://www.mouser.com/ds/2/447/Yageo_UPY-GP_NP0_16V-to-50V_9-358835.pdf; ComponentLink5URL: http://www.yageo.com/documents/recent/UPY-GPHC_X7R_6.3V-to-50V_8.pdf; ComponentLink5Description: http://www.yageo.com/documents/recent/UPY-GPHC_X7R_6.3V-to-50V_8.pdf; ComponentLink6URL: http://www.farnell.com/datasheets/1489800.pdf; ComponentLink6Description: http://www.farnell.com/datasheets/1489800.pdf
C19 = cap: Manufacturer: Samsung; Manufacturer Part Number: CL03A104KQ3NNNC; Tolerance: 10%; Voltage Rating: 6.3V; Dielectric: X5R; Supplier 1: Digi-Key; Stock 1: 100000; Pricing 1: 1=0.1, 10=0.021, 100=0.0092, 500=0.00656, 1000=0.00516, 2500=0.00469, 5000=0.00431 (USD); Mount: Surface Mount; Case/Package: 0201; Case Code (Metric): 0603; Case Code (Imperial): 0201; Contact Plating: Tin; Min Operating Temperature: -55°C; Max Operating Temperature: 85°C; Package Quantity: 1; Packaging: Tape and Reel; Voltage: 6.3V; Voltage Rating (DC): 6.3V; Length: 0.6mm; Height: 0.3mm; Width: 0.012inch; Thickness: 0.013inch; Depth: 0.3mm; Radiation Hardening: No; Lead Free: Lead Free; ComponentLink1URL: http://www1.futureelectronics.com/doc/SAMSUNG/CL03A104KQ3NNNC.pdf; ComponentLink1Description: http://www1.futureelectronics.com/doc/SAMSUNG/CL03A104KQ3NNNC.pdf; ComponentLink2URL: https://www.distrelec.biz/Web/Downloads/_e/ng/MLCC_CatalogDownload2013_ENG.pdf?mime=application%2Fpdf; ComponentLink2Description: https://www.distrelec.biz/Web/Downloads/_e/ng/MLCC_CatalogDownload2013_ENG.pdf?mime=application%2Fpdf; ComponentLink3URL: https://www.verical.com/server-webapp/html/getDatasheet?partID=355266; ComponentLink3Description: https://www.verical.com/server-webapp/html/getDatasheet?partID=355266
C20-C32 C96-C101 C106-C121 = cap: Manufacturer: Samsung; Manufacturer Part Number: CL03A104KQ3NNNC; Capacitance: .1uF; Tolerance: 10%; Voltage Rating: 6.3V; Dielectric: X5R; Supplier 1: Digi-Key; Stock 1: 100000; Pricing 1: 1=0.1, 10=0.021, 100=0.0092, 500=0.00656, 1000=0.00516, 2500=0.00469, 5000=0.00431 (USD); Mount: Surface Mount; Case/Package: 0201; Case Code (Metric): 0603; Case Code (Imperial): 0201; Contact Plating: Tin; Min Operating Temperature: -55°C; Max Operating Temperature: 85°C; Package Quantity: 1; Packaging: Tape and Reel; Voltage: 6.3V; Voltage Rating (DC): 6.3V; Length: 0.6mm; Height: 0.3mm; Width: 0.012inch; Thickness: 0.013inch; Depth: 0.3mm; Radiation Hardening: No; Lead Free: Lead Free; ComponentLink1URL: http://www1.futureelectronics.com/doc/SAMSUNG/CL03A104KQ3NNNC.pdf; ComponentLink1Description: http://www1.futureelectronics.com/doc/SAMSUNG/CL03A104KQ3NNNC.pdf; ComponentLink2URL: https://www.distrelec.biz/Web/Downloads/_e/ng/MLCC_CatalogDownload2013_ENG.pdf?mime=application%2Fpdf; ComponentLink2Description: https://www.distrelec.biz/Web/Downloads/_e/ng/MLCC_CatalogDownload2013_ENG.pdf?mime=application%2Fpdf; ComponentLink3URL: https://www.verical.com/server-webapp/html/getDatasheet?partID=355266; ComponentLink3Description: https://www.verical.com/server-webapp/html/getDatasheet?partID=355266; Supplier Part Number 1: 1276-1013-1-ND